# EasyEDA Pro project STM32G303的双FOC电机驱动.eprj, schematic axdr_v1.3, sheets 3 to 4 of 4

## Sheets
3 电源: Page Name: 电源; Page Size: A4; Version: V1.0
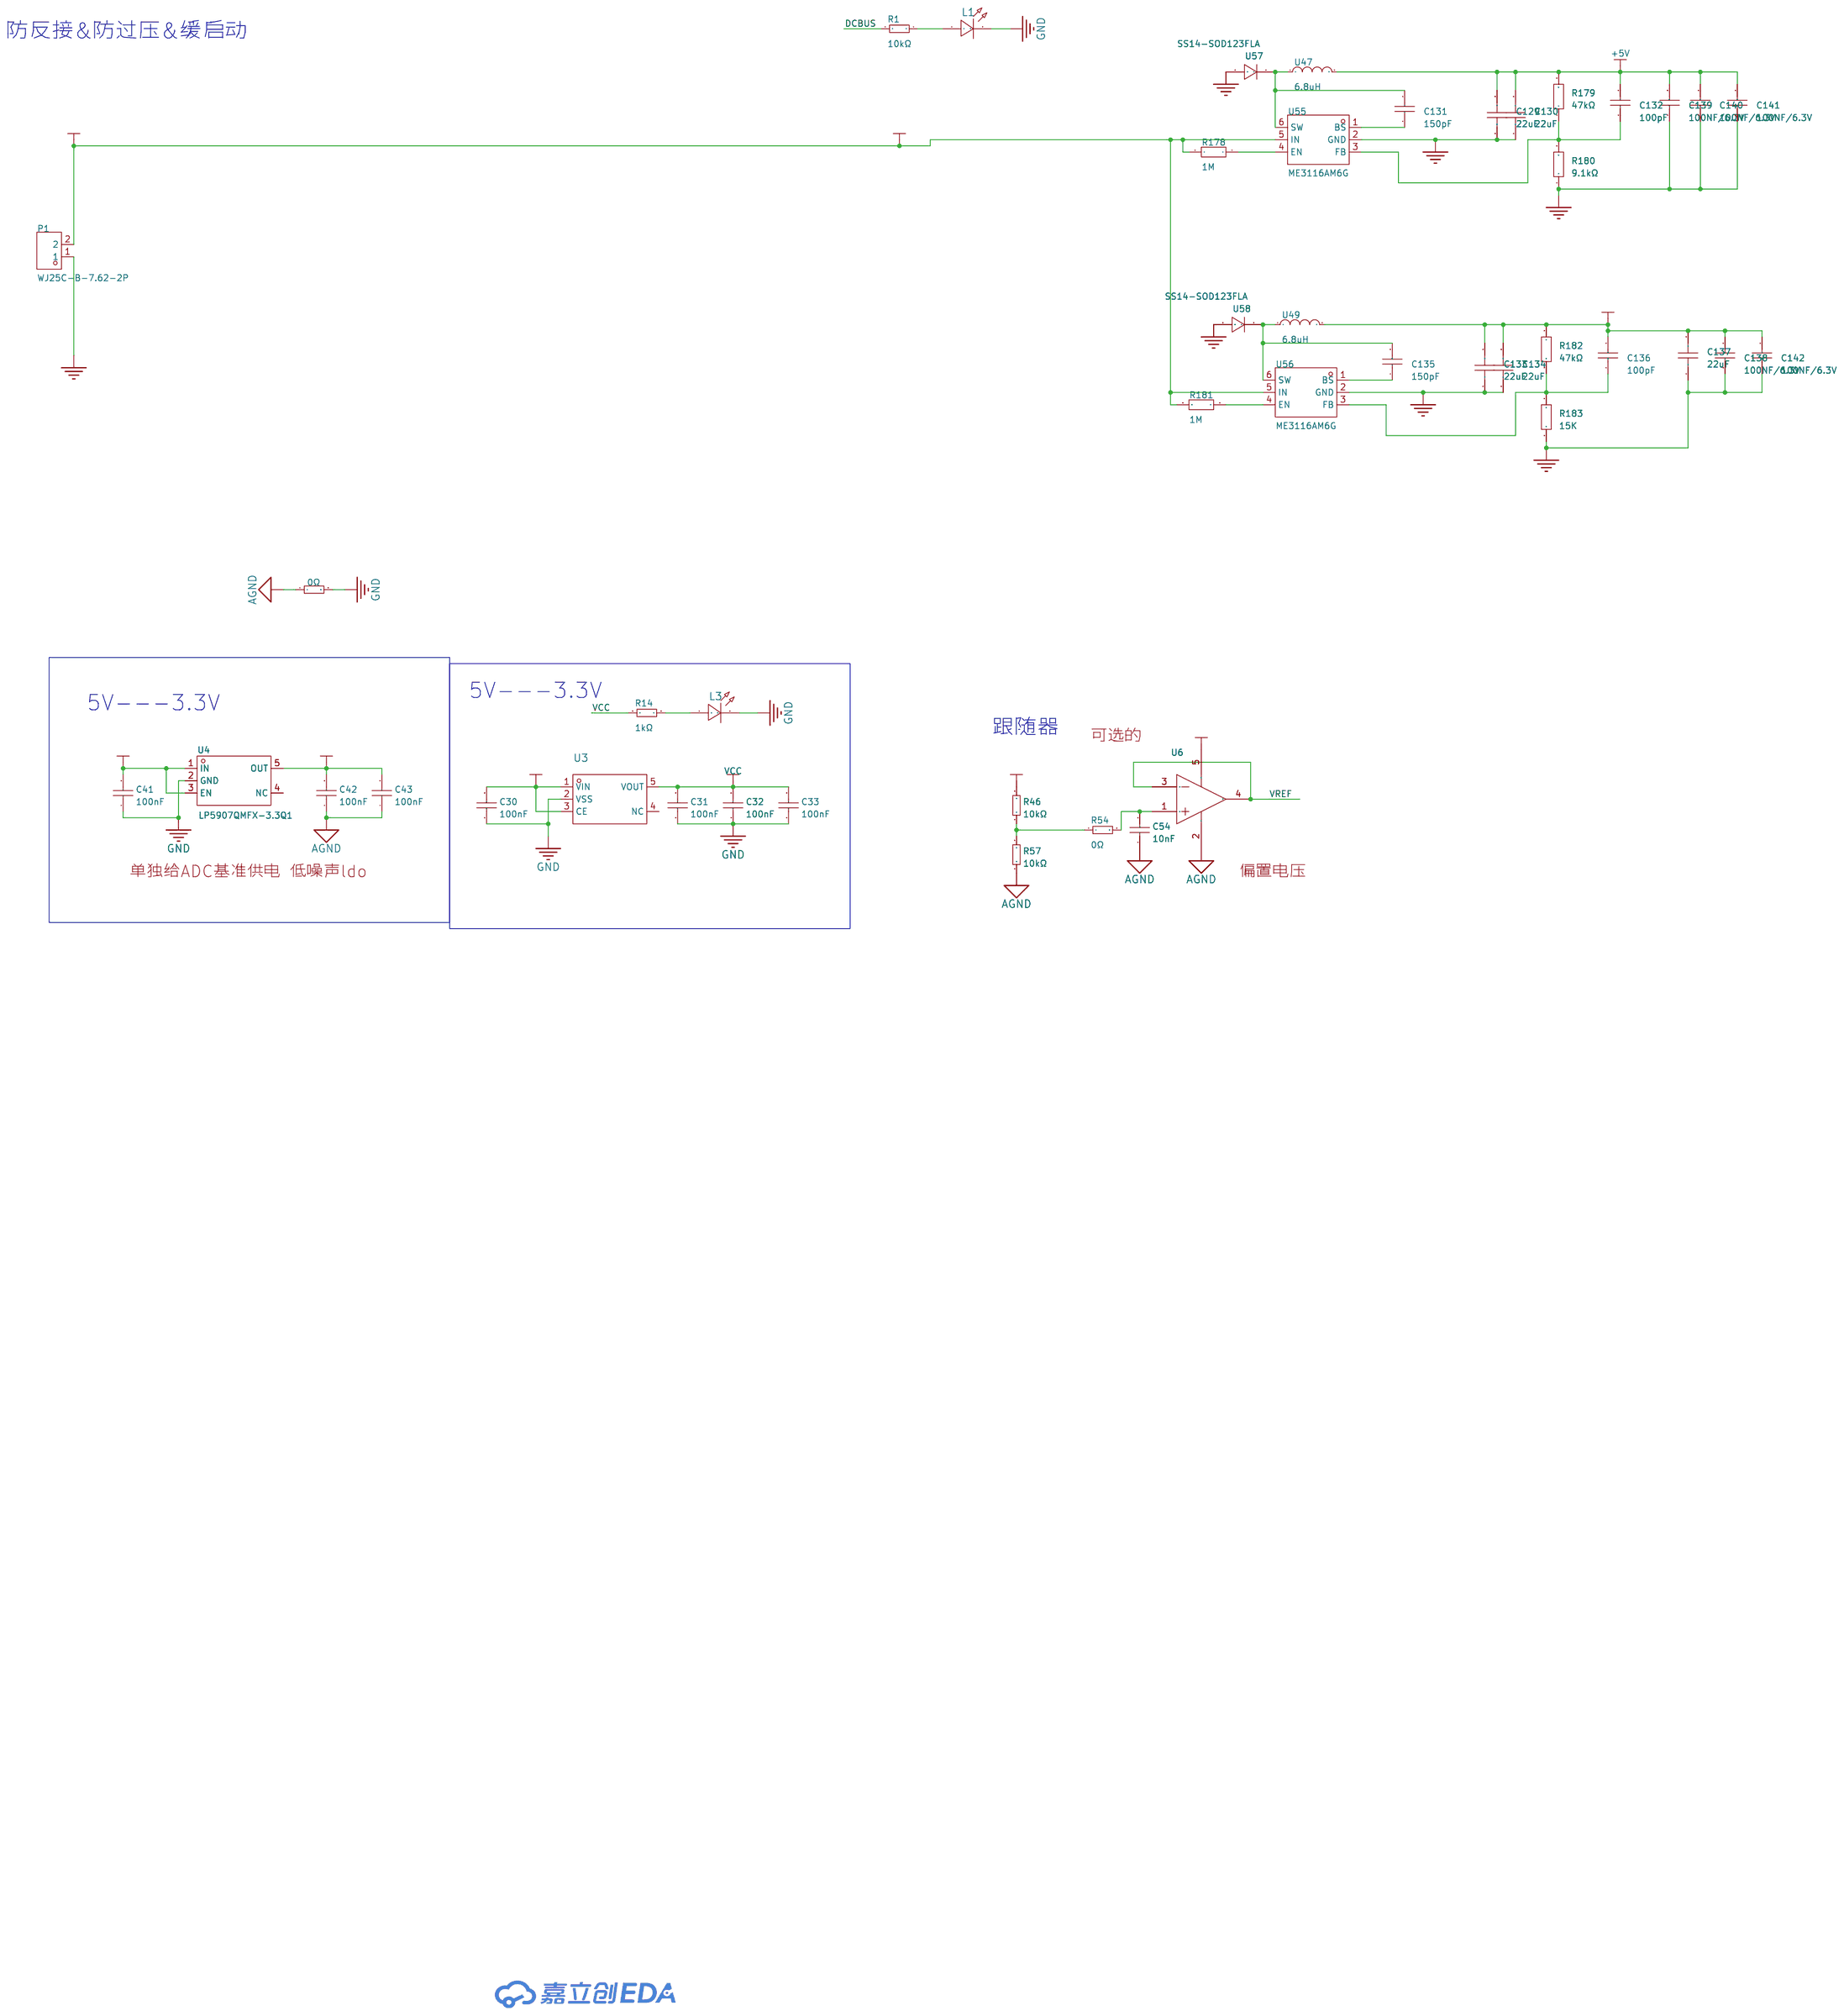
[diagram p3: 电源]
4 电机驱动2: Page Name: 电机驱动2; Page Size: A4; Version: V1.0
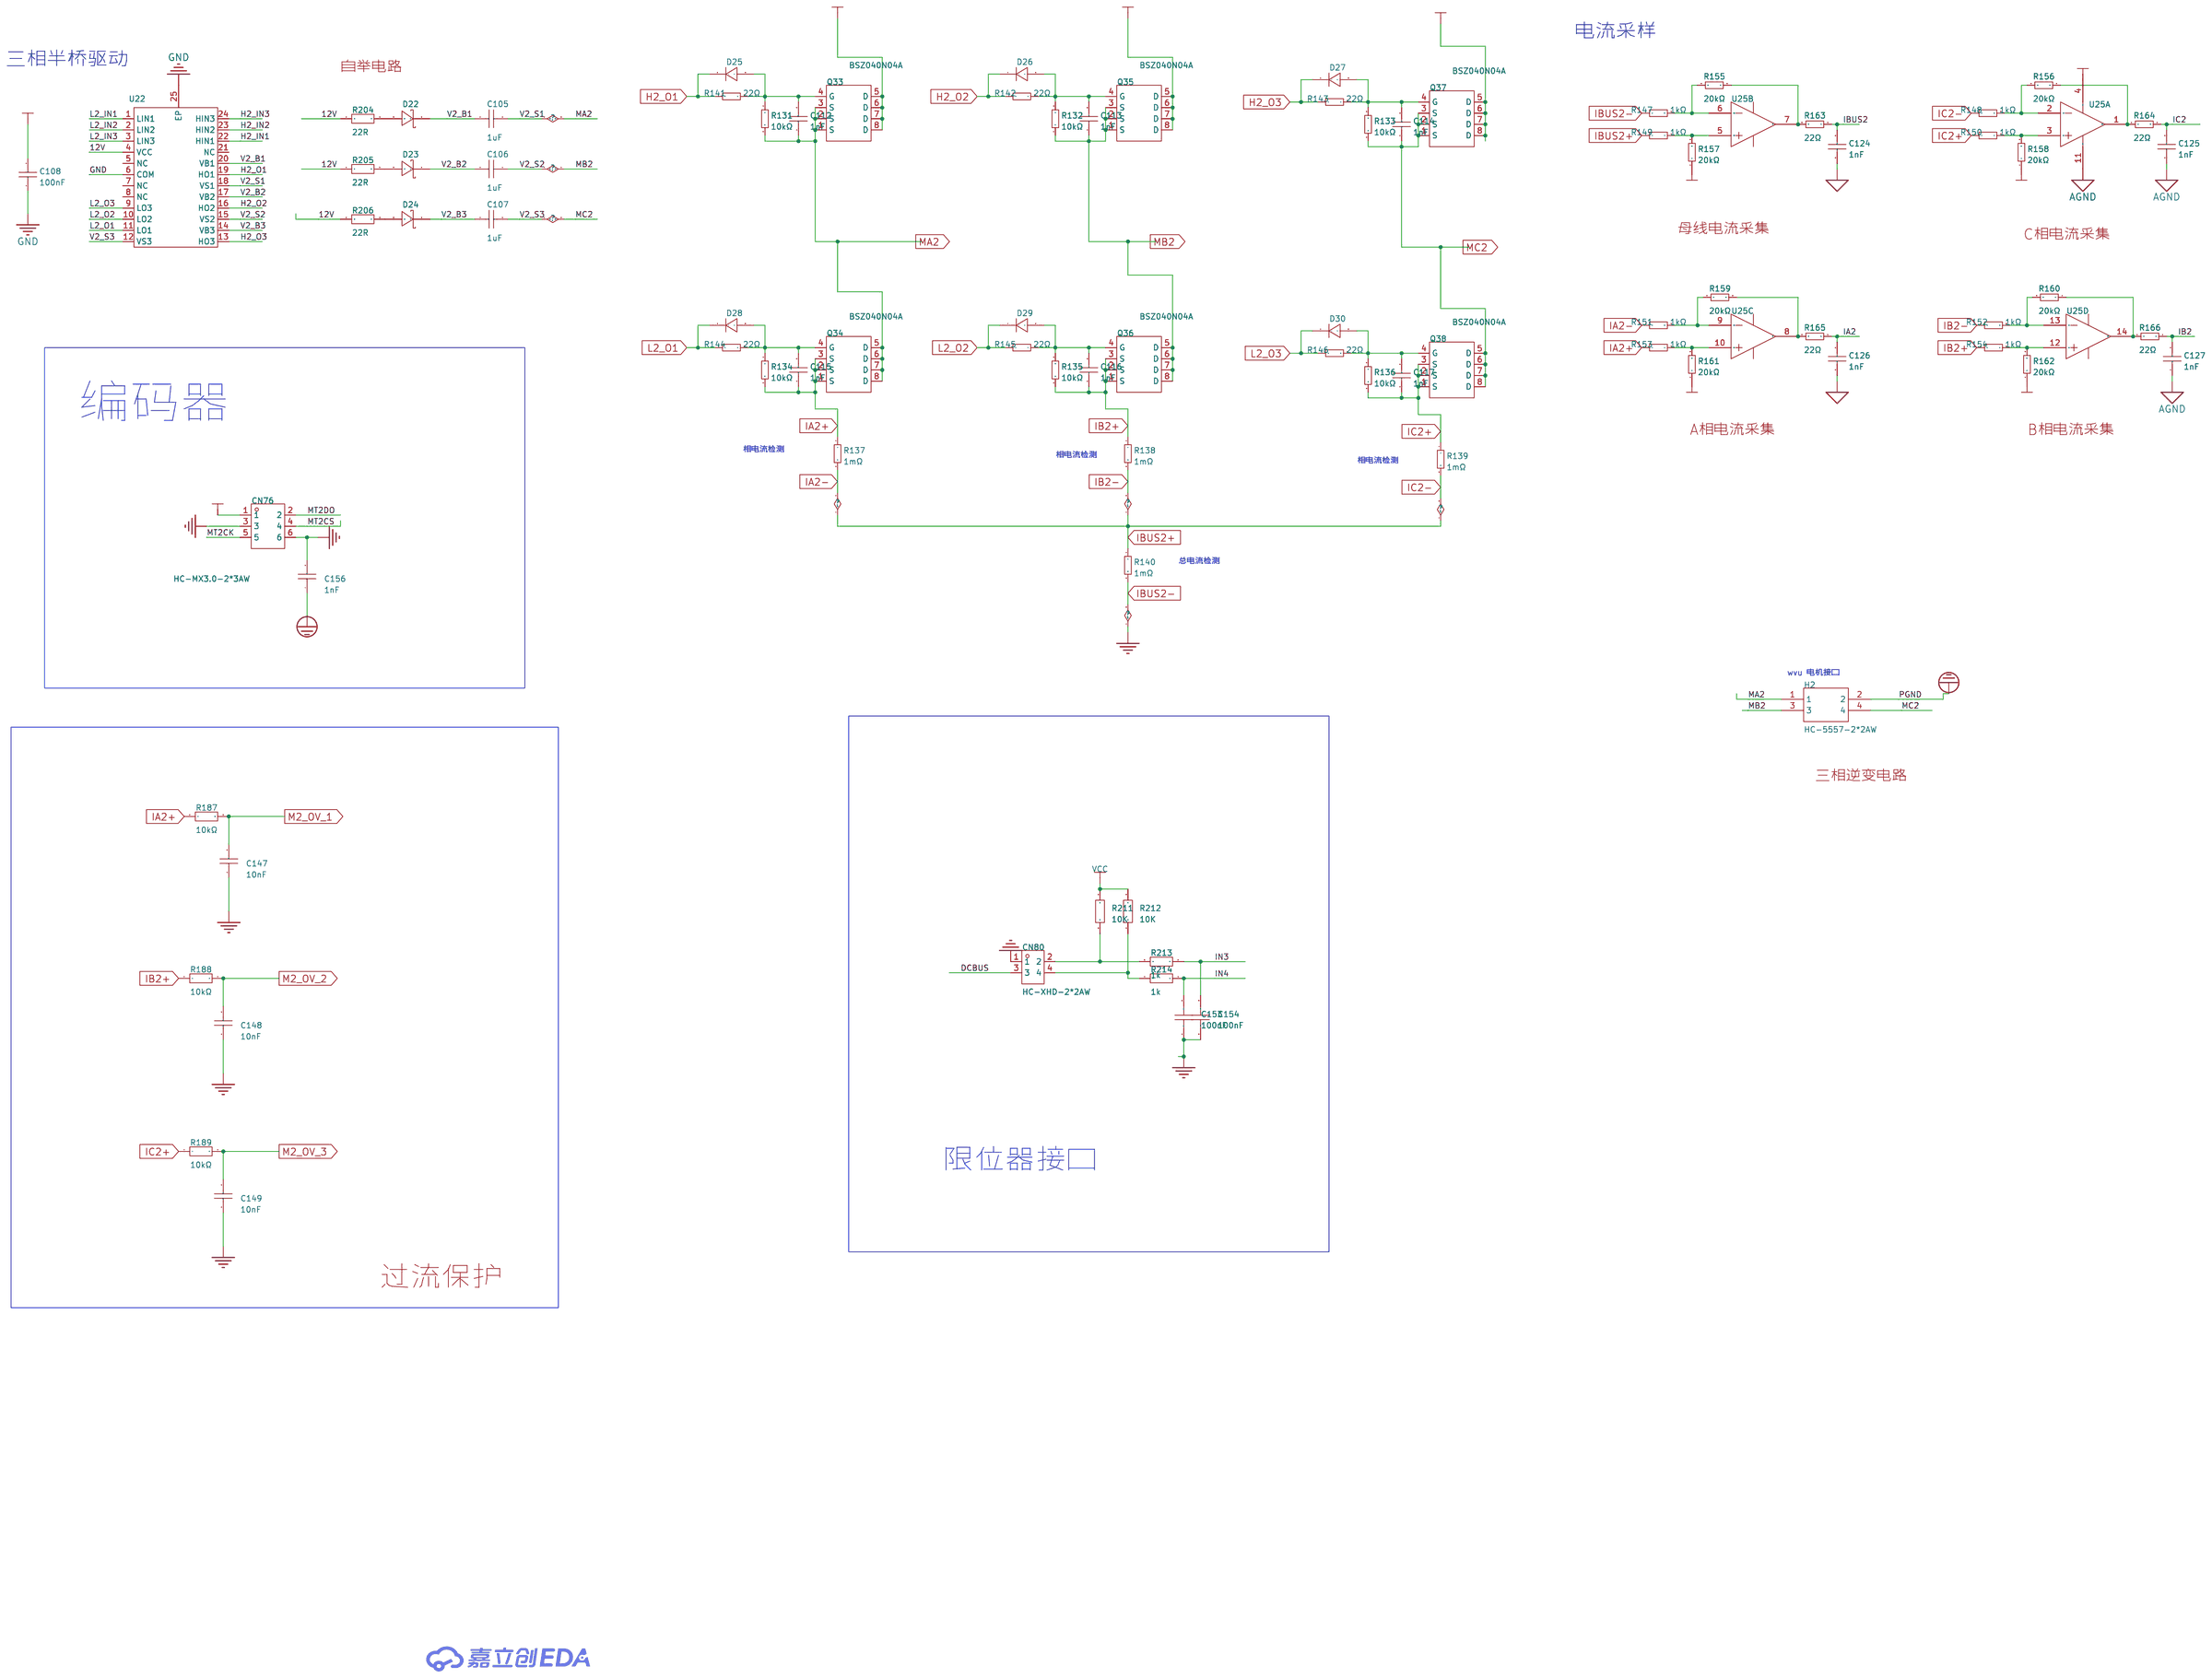
[diagram p4: 电机驱动2]

## Parts
sheet 电机驱动2
C105  1uF  [C0603_S]
C106  1uF  [C0603_S]
C107  1uF  [C0603_S]
C108  100nF  [C0603_S]
C112  1nF  [C0603_S]
C113  1nF  [C0603_S]
C114  1nF  [C0603_S]
C115  1nF  [C0603_S]
C116  1nF  [C0603_S]
C117  1nF  [C0603_S]
C124  1nF  [C0603_S]
C125  1nF  [C0603_S]
C126  1nF  [C0603_S]
C127  1nF  [C0603_S]
C147  10nF  [C0603]
C148  10nF  [C0603]
C149  10nF  [C0603]
C153  100nF  [C0603]
C154  100nF  [C0603]
C156  1nF  [C1206]
CN76  HC-MX3.0-2*3AW  [CONN-TH_6P-P3.00_HC-MX3.0-2X3AW_1]
CN80  HC-XHD-2*2AW  [CONN-TH_4P-P2.50_HCTL_HC-XHD-2X2AW]
D22  B16WS  [SOD-323_L1.8-W1.3-LS2.5-RD]
D23  B16WS  [SOD-323_L1.8-W1.3-LS2.5-RD]
D24  B16WS  [SOD-323_L1.8-W1.3-LS2.5-RD]
D25  B16WS  [SOD-323_L1.8-W1.3-LS2.5-RD]
D26  B16WS  [SOD-323_L1.8-W1.3-LS2.5-RD]
D27  B16WS  [SOD-323_L1.8-W1.3-LS2.5-RD]
D28  B16WS  [SOD-323_L1.8-W1.3-LS2.5-RD]
D29  B16WS  [SOD-323_L1.8-W1.3-LS2.5-RD]
D30  B16WS  [SOD-323_L1.8-W1.3-LS2.5-RD]
H2  HC-5557-2*2AW  [CONN-TH_4P-P4.20_5557-2X2AW]
Q33  BSZ040N04A  [POWERPAK-1212-8_L3.1-W3.1-P0.65-LS3.3-BL]
Q34  BSZ040N04A  [POWERPAK-1212-8_L3.1-W3.1-P0.65-LS3.3-BL]
Q35  BSZ040N04A  [POWERPAK-1212-8_L3.1-W3.1-P0.65-LS3.3-BL]
Q36  BSZ040N04A  [POWERPAK-1212-8_L3.1-W3.1-P0.65-LS3.3-BL]
Q37  BSZ040N04A  [POWERPAK-1212-8_L3.1-W3.1-P0.65-LS3.3-BL]
Q38  BSZ040N04A  [POWERPAK-1212-8_L3.1-W3.1-P0.65-LS3.3-BL]
R131  10kΩ  [R0603_S]
R132  10kΩ  [R0603_S]
R133  10kΩ  [R0603_S]
R134  10kΩ  [R0603_S]
R135  10kΩ  [R0603_S]
R136  10kΩ  [R0603_S]
R137  1mΩ  [R2512_S]
R138  1mΩ  [R2512_S]
R139  1mΩ  [R2512_S]
R140  1mΩ  [R2512_S]
R141  22Ω  [R0603_S]
R142  22Ω  [R0603_S]
R143  22Ω  [R0603_S]
R144  22Ω  [R0603_S]
R145  22Ω  [R0603_S]
R146  22Ω  [R0603_S]
R147  1kΩ  [R0603_S]
R148  1kΩ  [R0603_S]
R149  1kΩ  [R0603_S]
R150  1kΩ  [R0603_S]
R151  1kΩ  [R0603_S]
R152  1kΩ  [R0603_S]
R153  1kΩ  [R0603_S]
R154  1kΩ  [R0603_S]
R155  20kΩ  [R0603_S]
R156  20kΩ  [R0603_S]
R157  20kΩ  [R0603_S]
R158  20kΩ  [R0603_S]
R159  20kΩ  [R0603_S]
R160  20kΩ  [R0603_S]
R161  20kΩ  [R0603_S]
R162  20kΩ  [R0603_S]
R163  22Ω  [R0603_S]
R164  22Ω  [R0603_S]
R165  22Ω  [R0603_S]
R166  22Ω  [R0603_S]
R187  10kΩ  [R0603]
R188  10kΩ  [R0603]
R189  10kΩ  [R0603]
R204  22R  [R0603]
R205  22R  [R0603]
R206  22R  [R0603]
R211  10K  [R0603]
R212  10K  [R0603]
R213  1k  [R0603]
R214  1k  [R0603]
U22  FD6288Q  [QFN-24_L4.0-W4.0-P0.50-BL-EP2.6]
U25  RS624XQ  [TSSOP-14_L5.0-W4.4-P0.65-LS6.4-BL]  (sections 1,2,3,4)
sheet 电源
C30  100nF  [C0603_S]
C31  100nF  [C0603_S]
C32  100nF  [C0603_S]
C33  100nF  [C0603_S]
C41  100nF  [C0603_S]
C42  100nF  [C0603_S]
C43  100nF  [C0603_S]
C54  10nF  [C0603_S]
C129  22uF  [C0603]
C130  22uF  [C0603]
C131  150pF  [C0603]
C132  100pF  [C0603]
C133  22uF  [C0603]
C134  22uF  [C0603]
C135  150pF  [C0603]
C136  100pF  [C0603]
C137  22uF  [C0603]
C138  100NF/6.3V  [C0603]
C139  100NF/6.3V  [C0603]
C140  100NF/6.3V  [C0603]
C141  100NF/6.3V  [C0603]
C142  100NF/6.3V  [C0603]
L1  NCD0603R1  [LED0603_S]
L3  NCD0603R1  [LED0603_S]
P1  WJ25C-B-7.62-2P  [CONN-TH_2P-P7.62_WJ25C-B-7.62-2P]
R1  10kΩ  [R0603_S]
R12  0Ω  [R0603_S]
R14  1kΩ  [R0603_S]
R46  10kΩ  [R0603_S]
R54  0Ω  [R0603_S]
R57  10kΩ  [R0603_S]
R178  1M  [R0603]
R179  47kΩ  [R0603]
R180  9.1kΩ  [R0603]
R181  1M  [R0603]
R182  47kΩ  [R0603]
R183  15K  [R0603]
U3  XC6210B332MR  [SOT-23-5_L3.0-W1.7-P0.95-LS2.8-BR]
U4  LP5907QMFX-3.3Q1  [SOT-23-5_L3.0-W1.7-P0.95-LS2.8-BR]
U6  LM321MF/NOPB  [SOT-23-5_L3.0-W1.7-P0.95-LS2.8-BR]
U47  6.8uH  [IND-SMD_L4.0-W4.0]
U49  6.8uH  [IND-SMD_L4.0-W4.0]
U55  ME3116AM6G  [SOT-23-6_L2.9-W1.6-P0.95-LS2.8-BL]
U56  ME3116AM6G  [SOT-23-6_L2.9-W1.6-P0.95-LS2.8-BL]
U57  SS14-SOD123FLA  [SOD-123F_L2.8-W1.7-LS3.7-RD]
U58  SS14-SOD123FLA  [SOD-123F_L2.8-W1.7-LS3.7-RD]

## Library data of the parts
C105-C107 = C0603_S: Pin Type: IN; Supplier Part: C1604; Check: true
C30-C33 C41-C43 C108 = 0603B104K500NT: 容值:100nF;精度:±10%;额定电压:50V;材质(温度系数):X7R;; LCSC Part Name: 100nF ±10% 50V; Supplier Part: C30926; Manufacturer: FH(风华); Supplier Footprint: 0603; JLCPCB Part Class: Extended Part; Datasheet: https://atta.szlcsc.com/upload/public/pdf/source/20200305/C486355_26A10D38EF8C2A5C37091D0039909270.pdf; Supplier: LCSC; Tolerance: ±10%; Voltage Rated: 50V; Temperature Coefficient: X7R; Pin Type: IN; Check: true
C112-C117 C124-C127 = 0603B102K500NT: 容值:1nF;精度:±10%;额定电压:50V;材质(温度系数):X7R;; LCSC Part Name: 1nF ±10% 50V; Supplier Part: C44369; Manufacturer: FH(风华); Supplier Footprint: 0603; JLCPCB Part Class: Extended Part; Datasheet: https://atta.szlcsc.com/upload/public/pdf/source/20200305/C486355_26A10D38EF8C2A5C37091D0039909270.pdf; Supplier: LCSC; Tolerance: ±10%; Voltage Rated: 50V; Temperature Coefficient: X7R; Pin Type: IN; Check: true
C147-C149 = 0603B103K500NT: 容值:10nF;精度:±10%;额定电压:50V;材质(温度系数):X7R;; LCSC Part Name: 10nF ±10% 50V; Supplier Part: C57112; Manufacturer: FH(风华); Supplier Footprint: 0603; JLCPCB Part Class: Basic Part; Datasheet: https://atta.szlcsc.com/upload/public/pdf/source/20200305/C486355_26A10D38EF8C2A5C37091D0039909270.pdf; Supplier: LCSC; Tolerance: ±10%; Voltage Rated: 50V; Temperature Coefficient: X7R
C153 C154 = CAP_0603: Supplier Footprint: 0603
C156 = 1206B102K202NT: 容值:1nF;精度:±10%;额定电压:2kV;温度系数:X7R;; LCSC Part Name: 1nF ±10% 2kV; Supplier Part: C9196; Manufacturer: FH(风华); Supplier Footprint: 1206; JLCPCB Part Class: 基础库; Datasheet: https://atta.szlcsc.com/upload/public/pdf/source/20200305/C486355_26A10D38EF8C2A5C37091D0039909270.pdf; Supplier: LCSC; Tolerance: ±10%; Voltage Rating: 2kV; Temperature Coefficient: X7R
CN76 = HC-MX3.0-2*3AW: 插针结构:2x3P;间距:3mm;安装方式:弯插;参考系列:Micro-Fit(MX 3.0);总PIN数:6P;排数:2;每排PIN数:3;行距:3mm;额定电流:5A;触头材质:黄铜;触头镀层:锡;工作温度范围:-25℃~+85℃;; LCSC Part Name: 2x3P 间距:3mm 弯插 系列:Micro-Fit(MX 3.0); Supplier Part: C3294384; Manufacturer: HCTL(华灿天禄); Supplier Footprint: 弯插,P=3mm; JLCPCB Part Class: 扩展库; Datasheet: https://atta.szlcsc.com/upload/public/pdf/source/20240325/6515A412CF75DC76B766B405583CF347.pdf; Supplier: LCSC; Pins Structure: 2x3P; Pitch: 3mm; Mounting Style: 弯插; Reference Series: Micro-Fit(MX 3.0); Number of Pins: 6P; Number of Rows: 2; Number of PINs Per Row: 3; Row Spacing: 3mm; Current Rating (Max): 5A; Contact Material: 黄铜; Contact Plating: 锡; Operating Temperature Range: -25℃~+85℃; Rated Voltage (Max): 250V; Plastic Material: PA66; Supplementary Features: 鱼叉脚(塑料); Colour: 黑色
CN80 = HC-XHD-2*2AW: 插针结构:2x2P;间距:2.5mm;安装方式:弯插;参考系列:DF1B;总PIN数:4P;排数:2;每排PIN数:2;行距:2.5mm;额定电流:3A;触头材质:黄铜;触头镀层:锡;工作温度范围:-25℃~+85℃;; LCSC Part Name: 2x2P 间距:2.5mm 弯插 系列:DF1B; Supplier Part: C2845660; Manufacturer: HCTL(华灿天禄); Supplier Footprint: 弯插,P=2.5mm; JLCPCB Part Class: 扩展库; Datasheet: https://atta.szlcsc.com/upload/public/pdf/source/20240524/4C041307FC85BAB65780156B6CC34740.pdf; Supplier: LCSC; Pins Structure: 2x2P; Pitch: 2.5mm; Mounting Style: 弯插; Reference Series: DF1B; Number of Pins: 4P; Number of Rows: 2; Number of PINs Per Row: 2; Row Spacing: 2.5mm; Current Rating (Max): 3A; Contact Material: 黄铜; Contact Plating: 锡; Operating Temperature Range: -25℃~+85℃; Rated Voltage (Max): 250V; Plastic Material: PA; Z-Height of the Board: 8.6mm; X-Length of Bottom Edge on Board (Spacing Line): 7.5mm; Y-Width of Bottom Edge on Board: 12.5mm
D22-D24 = B16WS_C364278: 直流反向耐压(Vr):40V;平均整流电流(Io):1A;正向压降(Vf):650mV@1A;; Supplier Part: C364278; Manufacturer: MDD; Supplier Footprint: SOD-323; JLCPCB Part Class: Extended Part; Datasheet: https://atta.szlcsc.com/upload/public/pdf/source/20190125/C364278_08C9E980565605CB111C36D3361AA1D7.pdf; Supplier: LCSC; Reverse Voltage (Vr): 40V; Average Rectified Current (Io): 1A; Forward Voltage (Vf@If): 650mV@1A; Check: true
D25-D30 = B16WS_C364278: 直流反向耐压(Vr):60V;平均整流电流(Io):1A;正向压降(Vf):700mV@1A;; Supplier Part: C364278; Manufacturer: MDD; Supplier Footprint: SOD-323; JLCPCB Part Class: Extended Part; Datasheet: https://atta.szlcsc.com/upload/public/pdf/source/20190125/C364278_08C9E980565605CB111C36D3361AA1D7.pdf; Supplier: LCSC; Reverse Voltage (Vr): 60V; Average Rectified Current (Io): 1A; Forward Voltage (Vf@If): 700mV@1A; Check: true
H2 = HC-5557-2*2AW: 插针结构:2x2P;间距:4.2mm;安装方式:弯插;参考系列:Mini-Fit(MX 4.2);总PIN数:4P;排数:2;每排PIN数:2;行距:4.2mm;额定电流:9A;触头材质:黄铜;触头镀层:锡;工作温度范围:-25℃~+85℃;; LCSC Part Name: 2x2P 间距:4.2mm 弯插 系列:Mini-Fit(MX 4.2); Supplier Part: C2845787; Manufacturer: HCTL(华灿天禄); Supplier Footprint: 弯插,P=4.2mm; JLCPCB Part Class: 扩展库; Datasheet: https://atta.szlcsc.com/upload/public/pdf/source/20230620/3AA4118B2C2E81189EA8FE45B17A7E9B.pdf; Supplier: LCSC; Pins Structure: 2x2P; Pitch: 4.2mm; Mounting Style: 弯插; Reference Series: Mini-Fit(MX 4.2); Number of Pins: 4P; Number of Rows: 2; Number of PINs Per Row: 2; Row Spacing: 4.2mm; Current Rating (Max): 9A; Contact Material: 黄铜; Contact Plating: 锡; Operating Temperature Range: -25℃~+85℃; Rated Voltage (Max): 600V; Plastic Material: PA66; Flame Retardant Rating: UL94V-0
Q33-Q38 = BSZ040N04A: 类型:1个N沟道;漏源电压(Vdss):40V;连续漏极电流(Id):47A;导通电阻(RDS(on)):5.3mΩ@10V,20A;耗散功率(Pd):29W;阈值电压(Vgs(th)):2.5V;; LCSC Part Name: 场效应管(MOSFET) BSZ040N04A; Supplier Part: C41379059; Manufacturer: KTP(科泰普); Supplier Footprint: PDFN-8L(3x3); Datasheet: https://atta.szlcsc.com/upload/public/pdf/source/20240914/2854D306B8FA293BB1052D2AE5D30D43.pdf; Supplier: LCSC; Type: 1个N沟道; Drain to Source Voltage: 40V; Current - Continuous Drain(Id): 47A; RDS(on): 5.3mΩ@10V,20A; Pd - Power Dissipation: 29W; Gate Threshold Voltage (Vgs(th)@Id): 2.5V; Gate Charge(Qg): 23nC@10V; Input Capacitance(Ciss@Vds): 1.106nF@20V; Reverse Transfer Capacitance (Crss@Vds): 30pF@20V; Operating Temperature: -55℃~+150℃
R1 R46 R57 R131-R136 = 0603WAF1002T5E: 阻值:10kΩ;精度:±1%;功率:100mW;温度系数:±100ppm/℃;电阻类型:厚膜电阻;; LCSC Part Name: 10kΩ ±1% 100mW 厚膜电阻; Supplier Part: C25804; Manufacturer: UNI-ROYAL(厚声); Supplier Footprint: 0603; JLCPCB Part Class: Basic Part; Datasheet: https://atta.szlcsc.com/upload/public/pdf/source/20200306/C422600_1E6D84923E4A46A82E41ADD87F860B5C.pdf; Supplier: LCSC; Tolerance: ±1%; Power(Watts): 100mW; Overload Voltage (Max): 75V; Temperature Coefficient: ±100ppm/℃; Type: 厚膜电阻; Operating Temperature Range: -55℃~+155℃; Pin Type: IN; Check: true
R137-R140 = LR2512D-3W-5mR-1%: 电阻类型:采样电阻;阻值:5mΩ;精度:±1%;功率:3W;温度系数:25ppm/℃~+50ppm/℃;安装方式:贴片;; LCSC Part Name: 5mΩ ±1% 3W; Supplier Part: C500739; Manufacturer: Milliohm(毫欧); Supplier Footprint: 2512; JLCPCB Part Class: Extended Part; Datasheet: https://atta.szlcsc.com/upload/public/pdf/source/20211008/27BCB003066C6550DC06C87D8395239C.pdf; Supplier: LCSC; Type: 采样电阻; Tolerance: ±1%; Power(Watts): 3W; Temperature Coefficient: 25ppm/℃~+50ppm/℃; Mounting Sytle: 贴片; Pin Type: IN; Check: true
R141-R146 R163-R166 = 0603WAF220JT5E: 阻值:22Ω;精度:±1%;功率:100mW;温度系数:±100ppm/℃;电阻类型:厚膜电阻;; LCSC Part Name: 22Ω ±1% 100mW 厚膜电阻; Supplier Part: C23345; Manufacturer: UNI-ROYAL(厚声); Supplier Footprint: 0603; JLCPCB Part Class: Basic Part; Datasheet: https://atta.szlcsc.com/upload/public/pdf/source/20200306/C422600_1E6D84923E4A46A82E41ADD87F860B5C.pdf; Supplier: LCSC; Tolerance: ±1%; Power(Watts): 100mW; Overload Voltage (Max): 75V; Temperature Coefficient: ±100ppm/℃; Type: 厚膜电阻; Operating Temperature Range: -55℃~+155℃; Pin Type: IN; Check: true
R147-R154 = RT0603BRD071KL: 电阻类型:薄膜电阻;阻值:1kΩ;精度:±0.1%;功率:100mW;; LCSC Part Name: 1kΩ ±0.1% 100mW; Supplier Part: C110776; Manufacturer: YAGEO(国巨); Supplier Footprint: 0603; JLCPCB Part Class: Extended Part; Datasheet: https://atta.szlcsc.com/upload/public/pdf/source/20170704/1499151282044.pdf; Supplier: LCSC; Type: 薄膜电阻; Tolerance: ±0.1%; Power(Watts): 100mW; Temperature Coefficient: ±25ppm/℃; Overload Voltage (Max): 75V; Operating Temperature Range: -55℃~+155℃; Pin Type: IN; Check: true
R155-R162 = RT0603BRD0720KL: 电阻类型:薄膜电阻;阻值:20kΩ;精度:±0.1%;功率:100mW;; LCSC Part Name: 20kΩ ±0.1% 100mW; Supplier Part: C723637; Manufacturer: YAGEO(国巨); Supplier Footprint: 0603; JLCPCB Part Class: Extended Part; Datasheet: https://atta.szlcsc.com/upload/public/pdf/source/20200814/C723637_57E5E8B3C02F5D5BA42E401EB3E82C8B.pdf; Supplier: LCSC; Type: 薄膜电阻; Tolerance: ±0.1%; Power(Watts): 100mW; Temperature Coefficient: ±25ppm/℃; Overload Voltage (Max): 75V; Operating Temperature Range: -55℃~+155℃; Pin Type: IN; Check: true
R187-R189 = 0603WAF1002T5E: 阻值:10kΩ;精度:±1%;功率:100mW;温度系数:±100ppm/℃;电阻类型:厚膜电阻;; LCSC Part Name: 10kΩ ±1% 100mW 厚膜电阻; Supplier Part: C25804; Manufacturer: UNI-ROYAL(厚声); Supplier Footprint: 0603; JLCPCB Part Class: Basic Part; Datasheet: https://atta.szlcsc.com/upload/public/pdf/source/20200306/C422600_1E6D84923E4A46A82E41ADD87F860B5C.pdf; Supplier: LCSC; Tolerance: ±1%; Power(Watts): 100mW; Overload Voltage (Max): 75V; Temperature Coefficient: ±100ppm/℃; Type: 厚膜电阻; Operating Temperature Range: -55℃~+155℃
R204-R206 R211-R214 = Res_0603: Supplier Footprint: 0603
U22 = FD6288Q: Supplier Part: C328453; Manufacturer: Fortior Tech(峰岹); Supplier Footprint: QFN-24-EP(4x4); JLCPCB Part Class: 扩展库; Datasheet: https://atta.szlcsc.com/upload/public/pdf/source/20181108/C328453_785547738DB9FC0123219FC22539EFAD.pdf; Supplier: LCSC; Check: true
U25 = RS624XQ: 超低噪声11nV/√Hz,7MHz,4通道运放; LCSC Part Name: 低噪声运放RS624XQ; Supplier Part: C237013; Manufacturer: RUNIC(润石); Supplier Footprint: TSSOP-14; JLCPCB Part Class: Extended Part; Datasheet: https://atta.szlcsc.com/upload/public/pdf/source/20180629/C237015_68A12BBC706A117D231179E6ED270A16.pdf; Supplier: LCSC; Number of Circuits: 4; Rail to Rail: 轨到轨; Slew Rate(SR): 0.5V/us; Current - Input Bias(Ib): 1pA; Gain Bandwidth Product(GBP): 1.1MHz; Output Current: 55mA; Operating Temperature: -40℃~+125℃; Check: true
C54 = 0603B103K500NT: 容值:10nF;精度:±10%;额定电压:50V;材质(温度系数):X7R;; LCSC Part Name: 10nF ±10% 50V; Supplier Part: C57112; Manufacturer: FH(风华); Supplier Footprint: 0603; JLCPCB Part Class: Basic Part; Datasheet: https://atta.szlcsc.com/upload/public/pdf/source/20200305/C486355_26A10D38EF8C2A5C37091D0039909270.pdf; Supplier: LCSC; Tolerance: ±10%; Voltage Rated: 50V; Temperature Coefficient: X7R; Pin Type: IN; Check: true
C129 C130 C133 C134 C137 = CL10A226MQ8NRNC: 容值:22uF;精度:±20%;额定电压:6.3V;材质(温度系数):X5R;; LCSC Part Name: 22uF ±20% 6.3V; Supplier Part: C59461; Manufacturer: SAMSUNG(三星); Supplier Footprint: 0603; JLCPCB Part Class: 基础库; Datasheet: https://atta.szlcsc.com/upload/public/pdf/source/20160218/1457707763339.pdf; Supplier: LCSC; Tolerance: ±20%; Voltage Rated: 6.3V; Temperature Coefficient: X5R
C131 C135 C138-C142 = 0603B151K500NT: 容值:150pF;精度:±10%;额定电压:50V;温度系数:X7R;; LCSC Part Name: 150pF ±10% 50V; Supplier Part: C1594; Manufacturer: FH(风华); Supplier Footprint: 0603; JLCPCB Part Class: 基础库; Datasheet: https://atta.szlcsc.com/upload/public/pdf/source/20200305/C486355_26A10D38EF8C2A5C37091D0039909270.pdf; Supplier: LCSC; Tolerance: ±10%; Voltage Rating: 50V; Temperature Coefficient: X7R
C132 C136 = CL10C101JB8NNNC: 容值:100pF;精度:±5%;额定电压:50V;材质(温度系数):C0G;; LCSC Part Name: 100pF ±5% 50V; Supplier Part: C14858; Manufacturer: SAMSUNG(三星); Supplier Footprint: 0603; JLCPCB Part Class: 基础库; Datasheet: https://atta.szlcsc.com/upload/public/pdf/source/20160218/1457707763339.pdf; Supplier: LCSC; Tolerance: ±5%; Voltage Rated: 50V; Temperature Coefficient: C0G
L1 L3 = NCD0603R1_C84263: 发光颜色:红色;功率:65mW;透镜颜色:无色透明;主波长:615nm~630nm;发光强度:80mcd~220mcd;发光角度:130°;工作温度:-30℃~+85℃;; LCSC Part Name: 红灯 0603红灯   正贴; Supplier Part: C84263; Manufacturer: 国星光电; Supplier Footprint: 0603; JLCPCB Part Class: Extended Part; Datasheet: https://atta.szlcsc.com/upload/public/pdf/source/20200820/C84263_DABC6A75E58F576973B407FDBA283D60.pdf; Supplier: LCSC; Emitted Color: 红色; Forward Voltage (VF): 1.6V~2.6V; Forward Current: 20mA; Power Dissipation: 65mW; Lens Color: 无色透明; Dominant Wavelength: 615nm~630nm; Luminous Intensity: 80mcd~220mcd; Viewing Angle: 130°; Operating Temperature: -30℃~+85℃; Check: true
P1 = WJ25C-B-7.62-2P: 隔板类型:两面;间距:7.62mm;结构:1x2P;安装方式:直针;引脚位置:中脚;排数:1;额定电流:24A;额定电压:250V;线规 - AWG:14~22;线规 - 平方毫米:2.5;工作温度范围:-40℃~+105℃;颜色:黑色;每排PIN数:2;; LCSC Part Name: 7.62mm 1x2P 每排P数:2 排数:1 直针 中脚; Supplier Part: C8422; Manufacturer: KANGNEX(康奈克斯电气); Supplier Footprint: 插件,P=7.62mm; JLCPCB Part Class: 扩展库; Datasheet: https://atta.szlcsc.com/upload/public/pdf/source/20191225/C8422_6D6D8D85FF1841F2196C54E14890EE21.pdf; Supplier: LCSC; Barrier Type: 两面; Pitch: 7.62mm; Structure: 1x2P; Mounting Style: 直针; Pin Location: 中脚; Number of Pins: 2P; Number of Rows: 1; Current Rating (Max): 24A; Voltage Rating (Max): 250V; Wire Gauge - AWG: 14~22; Wire Gauge - mm2: 2.5; Operating Temperature Range: -40℃~+105℃; Color: 黑色; Number of PINs Per Row: 2
R12 R54 = RS-03000FT: 阻值:0Ω;精度:±1%;功率:100mW;; LCSC Part Name: 0Ω ±1% 100mW; Supplier Part: C136582; Manufacturer: FH(风华); Supplier Footprint: 0603; JLCPCB Part Class: Extended Part; Datasheet: https://atta.szlcsc.com/upload/public/pdf/source/20171106/C136582_15099532019501092527.pdf; Supplier: LCSC; Tolerance: ±1%; Power(Watts): 100mW; Overload Voltage (Max): 50V; Operating Temperature Range: -55℃~+155℃; Pin Type: IN; Check: true
R14 = RC0603FR-071KL: 电阻类型:厚膜电阻;阻值:1kΩ;精度:±1%;功率:100mW;; LCSC Part Name: 1kΩ ±1% 100mW; Supplier Part: C22548; Manufacturer: YAGEO(国巨); Supplier Footprint: 0603; JLCPCB Part Class: Extended Part; Datasheet: https://atta.szlcsc.com/upload/public/pdf/source/20180312/7BD3618A8B6324EA6280B0497A051AB7.pdf; Supplier: LCSC; Type: 厚膜电阻; Tolerance: ±1%; Power(Watts): 100mW; Temperature Coefficient: ±100ppm/℃; Overload Voltage (Max): 75V; Operating Temperature Range: -55℃~+155℃; Pin Type: IN; Check: true
R178 R181 = 0603WAF4703T5E: 电阻类型:厚膜电阻;阻值:470kΩ;精度:±1%;功率:100mW;最大工作电压:75V;温度系数:±100ppm/℃;; LCSC Part Name: 470kΩ ±1% 100mW 厚膜电阻; Supplier Part: C23178; Manufacturer: UNI-ROYAL(厚声); Supplier Footprint: 0603; JLCPCB Part Class: 基础库; Datasheet: https://atta.szlcsc.com/upload/public/pdf/source/20200306/C422600_1E6D84923E4A46A82E41ADD87F860B5C.pdf; Supplier: LCSC; Type: 厚膜电阻; Tolerance: ±1%; Power(Watts): 100mW; Overload Voltage (Max): 75V; Temperature Coefficient: ±100ppm/℃; Operating Temperature Range: -55℃~+155℃
R179 R180 R182 R183 = 0603WAF4702T5E: 电阻类型:厚膜电阻;阻值:47kΩ;精度:±1%;功率:100mW;最大工作电压:75V;温度系数:±100ppm/℃;; LCSC Part Name: 47kΩ ±1% 100mW 厚膜电阻; Supplier Part: C25819; Manufacturer: UNI-ROYAL(厚声); Supplier Footprint: 0603; JLCPCB Part Class: 基础库; Datasheet: https://atta.szlcsc.com/upload/public/pdf/source/20200306/C422600_1E6D84923E4A46A82E41ADD87F860B5C.pdf; Supplier: LCSC; Type: 厚膜电阻; Tolerance: ±1%; Power(Watts): 100mW; Overload Voltage (Max): 75V; Temperature Coefficient: ±100ppm/℃; Operating Temperature Range: -55℃~+155℃
U3 = XC6210B332MR_C424705: 输出类型:固定;输出极性:正;最大输入电压:6V;输出电压:3.3V;输出电流:900mA;电源纹波抑制比(PSRR):60dB@(1kHz);; Supplier Part: C424705; Manufacturer: TOREX(特瑞仕); Supplier Footprint: SOT-25; JLCPCB Part Class: Extended Part; Datasheet: https://atta.szlcsc.com/upload/public/pdf/source/20190903/C424705_1DFB2113A9A78D399905DBF688657204.pdf; Supplier: LCSC; Output Type: 固定; Output Polarity: 正; Number of Outputs: 1; Maximum Input Voltage: 6V; Output Voltage: 3.3V; Dropout Voltage: 75mV@(100mA); Output Current: 900mA; Power Supply Rejection Ratio (PSRR): 60dB@(1kHz); Power Supply Rejection Ratio (PRSS): 90dB@(100Hz),60dB@(100kHz); Check: true
U4 = LP5907QMFX-3.3Q1: 输出类型:固定;输出极性:正;最大输入电压:5.5V;输出电压:3.3V;输出电流:250mA;电源纹波抑制比(PSRR):90dB;; Supplier Part: C130005; Manufacturer: TI(德州仪器); Supplier Footprint: SOT-23-5; JLCPCB Part Class: Extended Part; Datasheet: https://atta.szlcsc.com/upload/public/pdf/source/20170918/C130005_1505703244961975089.pdf; Supplier: LCSC; Output Type: 固定; Output Polarity: 正; Number of Outputs: 1; Maximum Input Voltage: 5.5V; Output Voltage: 3.3V; Dropout Voltage: 250mV@(250mA); Output Current: 250mA; Power Supply Rejection Ratio (PSRR): 90dB; Power Supply Rejection Ratio (PRSS): 90dB@(100Hz),60dB@(100kHz); Check: true
U6 = LM321MF/NOPB: 放大器组数:1;; Supplier Part: C131103; Manufacturer: TI(德州仪器); Supplier Footprint: SOT-23-5; JLCPCB Part Class: ExtendedPart; Datasheet: https://atta.szlcsc.com/upload/public/pdf/source/20180528/C131103_48811F2B458DDCB2A659958D3ACA9936.pdf; Supplier: LCSC; Number of Circuits: 1; Check: true
U47 U49 = ANR4030T6R8M: 电感值:6.8uH;精度:±20%;额定电流:1.62A;饱和电流(Isat):2.79A;类型:磁胶屏蔽绕线电感;; LCSC Part Name: 6.8uH ±20% 2.79A; Supplier Part: C6364812; Manufacturer: APV(爱普微); Supplier Footprint: SMD,4x4mm; JLCPCB Part Class: 扩展库; Datasheet: https://atta.szlcsc.com/upload/public/pdf/source/20230920/8B21AEAFB8742CA79E47C90276D2A04D.pdf; Supplier: LCSC; Tolerance: ±20%; Rated Current: 1.62A; Saturation Current (Isat): 2.79A; Type: 磁胶屏蔽绕线电感
U55 U56 = ME3116AM6G: Supplier Part: C427569; Supplier Footprint: SOT-23-6; JLCPCB Part Class: 扩展库; Supplier: LCSC
U57 U58 = SS14-SOD123FLA: Supplier Part: C9900005410; Supplier Footprint: SOD-123_L2.7-W1.6-LS3.8; JLCPCB Part Class: 扩展库; Supplier: LCSC

## Nets
12V: C108.2 C133.2 C134.2 C136.2 C137.2 C138.2 C142.2 R182.2 R204.1 R205.1 R206.1 U22.4(VCC) U49.2 ; also on sheet 1 2
+5V: C30.2 C41.2 C129.2 C130.2 C132.2 C139.2 C140.2 C141.2 CN76.1 R179.2 U3.1(VIN) U3.3(CE) U4.1(IN) U4.3(EN) U47.2 ; also on sheet 1 2
AGND: C42.1 C43.1 C54.1 C125.1 C127.1 C147.1 C148.1 C149.1 R12.1 R57.1 U6.2(V-) U25.11(V-) ; also on sheet 1 2
AVCC: C42.2 C43.2 R46.2 U4.5(OUT) U6.5(V+) U25.4(V+) ; also on sheet 1 2
GND: C30.1 C31.1 C32.1 C33.1 C41.1 C108.1 C124.1 C126.1 C129.1 C130.1 C133.1 C134.1 C137.1 C138.1 C139.1 C140.1 C141.1 C142.1 C153.1 C154.1 C156.2 CN76.3 CN76.6 CN80.1 L1.2 L3.2 P1.1 R12.2 R140.2 R147.1 R180.1 R183.1 U3.2(VSS) U4.2(GND) U22.6(COM) U22.25(EP) U55.2(GND) U56.2(GND) U57.2 U58.2 ; also on sheet 1 2
PGND: C156.1 H2.2 ; also on sheet 2
V2_B1: C105.2 D22.1 U22.20(VB1)
V2_B2: C106.2 D23.1 U22.17(VB2)
V2_B3: C107.2 D24.1 U22.14(VB3)
VCC: C31.2 C32.2 C33.2 R14.1 R211.2 R212.2 U3.5(VOUT) ; also on sheet 1 2
DCBUS: CN80.3 P1.2 Q33.5(D) Q33.6(D) Q33.7(D) Q33.8(D) Q35.5(D) Q35.6(D) Q35.7(D) Q35.8(D) Q37.5(D) Q37.6(D) Q37.7(D) Q37.8(D) R1.2 R178.2 R181.2 U55.5(IN) U56.5(IN) ; also on sheet 1 2
H2_IN1: U22.22(HIN1) ; also on sheet 1
H2_IN2: U22.23(HIN2) ; also on sheet 1
H2_IN3: U22.24(HIN3) ; also on sheet 1
H2_O1: D25.1(-) R141.2 U22.19(HO1)
H2_O2: D26.1(-) R142.2 U22.16(HO2)
H2_O3: D27.1(-) R143.2 U22.13(HO3)
IA2: C126.2 R165.1 ; also on sheet 1
IA2+: C115.1 Q34.1(S) Q34.2(S) Q34.3(S) R134.2 R137.1 R153.1 R187.1
IA2-: R137.2 R138.2 R139.2 R140.1 R148.1 R149.1 R151.1 R152.1
IB2: C127.2 R166.1 ; also on sheet 1
IB2+: C116.1 Q36.1(S) Q36.2(S) Q36.3(S) R135.2 R138.1 R154.1 R188.1
IBUS2: C124.2 R163.1 ; also on sheet 1
IC2: C125.2 R164.1 ; also on sheet 1
IC2+: C117.1 Q38.1(S) Q38.2(S) Q38.3(S) R136.2 R139.1 R150.1 R189.1
IN3: C154.2 R213.1 ; also on sheet 1
IN4: C153.2 R214.1 ; also on sheet 1
L2_IN1: U22.1(LIN1) ; also on sheet 1
L2_IN2: U22.2(LIN2) ; also on sheet 1
L2_IN3: U22.3(LIN3) ; also on sheet 1
L2_O1: D28.1(-) R144.2 U22.11(LO1)
L2_O2: D29.1(-) R145.2 U22.10(LO2)
L2_O3: D30.1(-) R146.2 U22.9(LO3)
M2_OV_1: C147.2 R187.2 ; also on sheet 1
M2_OV_2: C148.2 R188.2 ; also on sheet 1
M2_OV_3: C149.2 R189.2 ; also on sheet 1
MA2: C105.1 C112.1 H2.1 Q33.1(S) Q33.2(S) Q33.3(S) Q34.5(D) Q34.6(D) Q34.7(D) Q34.8(D) R131.2 U22.18(VS1)
MB2: C106.1 C113.1 H2.3 Q35.1(S) Q35.2(S) Q35.3(S) Q36.5(D) Q36.6(D) Q36.7(D) Q36.8(D) R132.2 U22.15(VS2)
MC2: C107.1 C114.1 H2.4 Q37.1(S) Q37.2(S) Q37.3(S) Q38.5(D) Q38.6(D) Q38.7(D) Q38.8(D) R133.2 U22.12(VS3)
MT2CK: CN76.5 ; also on sheet 1
MT2CS: CN76.4 ; also on sheet 1
MT2DO: CN76.2 ; also on sheet 1
VREF: R157.1 R158.1 R161.1 R162.1 U6.3(IN-) U6.4(OUT) ; also on sheet 2
$3N1206: L1.1 R1.1
$3N1659: L3.1 R14.2
$3N4350: R178.1 U55.4(EN)
$3N4694: C131.2 U47.1 U55.6(SW) U57.1
$3N4858: C131.1 U55.1(BS)
$3N4949: C132.1 R179.1 R180.2 U55.3(FB)
$3N5491: R181.1 U56.4(EN)
$3N5497: C135.2 U49.1 U56.6(SW) U58.1
$3N5510: C135.1 U56.1(BS)
$3N6069: C136.1 R182.1 R183.2 U56.3(FB)
$3N15639: R46.1 R54.1 R57.2
$3N15644: C54.2 R54.2 U6.1(IN+)
$4N3072: C112.2 D25.2(+) Q33.4(G) R131.1 R141.1
$4N3074: C115.2 D28.2(+) Q34.4(G) R134.1 R144.1
$4N3077: C113.2 D26.2(+) Q35.4(G) R132.1 R142.1
$4N3079: C116.2 D29.2(+) Q36.4(G) R135.1 R145.1
$4N3082: C114.2 D27.2(+) Q37.4(G) R133.1 R143.1
$4N3084: C117.2 D30.2(+) Q38.4(G) R136.1 R146.1
$4N4584: R156.1 R164.2 U25.1(OUTA)
$4N4586: R150.2 R158.2 U25.3(+INA)
$4N4587: R148.2 R156.2 U25.2(-INA)
$4N4589: R155.1 R163.2 U25.7(OUTB)
$4N4591: R149.2 R157.2 U25.5(+INB)
$4N4592: R147.2 R155.2 U25.6(-INB)
$4N4598: R160.1 R166.2 U25.14(OUTD)
$4N4600: R154.2 R162.2 U25.12(+IND)
$4N4601: R152.2 R160.2 U25.13(-IND)
$4N4605: R159.1 R165.2 U25.8(OUTC)
$4N4607: R153.2 R161.2 U25.10(+INC)
$4N4608: R151.2 R159.2 U25.9(-INC)
$4N18745: D22.2 R204.2
$4N18747: D23.2 R205.2
$4N18749: D24.2 R206.2
$4N19011: CN80.2 R211.1 R213.2
$4N19015: CN80.4 R212.1 R214.2

Not connected (* = marked no-connect by the designer): U3 4(NC); U4 4(NC); U22 5(NC) 7(NC) 8(NC) 21(NC)

## Notes on the sheets
sheet 3
- 防反接&防过压&缓启动
- 5V---3.3V
- 5V---3.3V
- 跟随器
- 可选的
- 单独给ADC基准供电 低噪声ldo
- 偏置电压
sheet 4
- 电流采样
- 三相半桥驱动
- 自举电路
- 母线电流采集
- C相电流采集
- 编码器
- A相电流采集
- B相电流采集
- 相电流检测
- 相电流检测
- 相电流检测
- 总电流检测
- wvu 电机接口
- 三相逆变电路
- 限位器接口
- 过流保护
